# EasyEDA Pro project kuafu01_030内部老化方案.eprj, board PCB4 (continued)
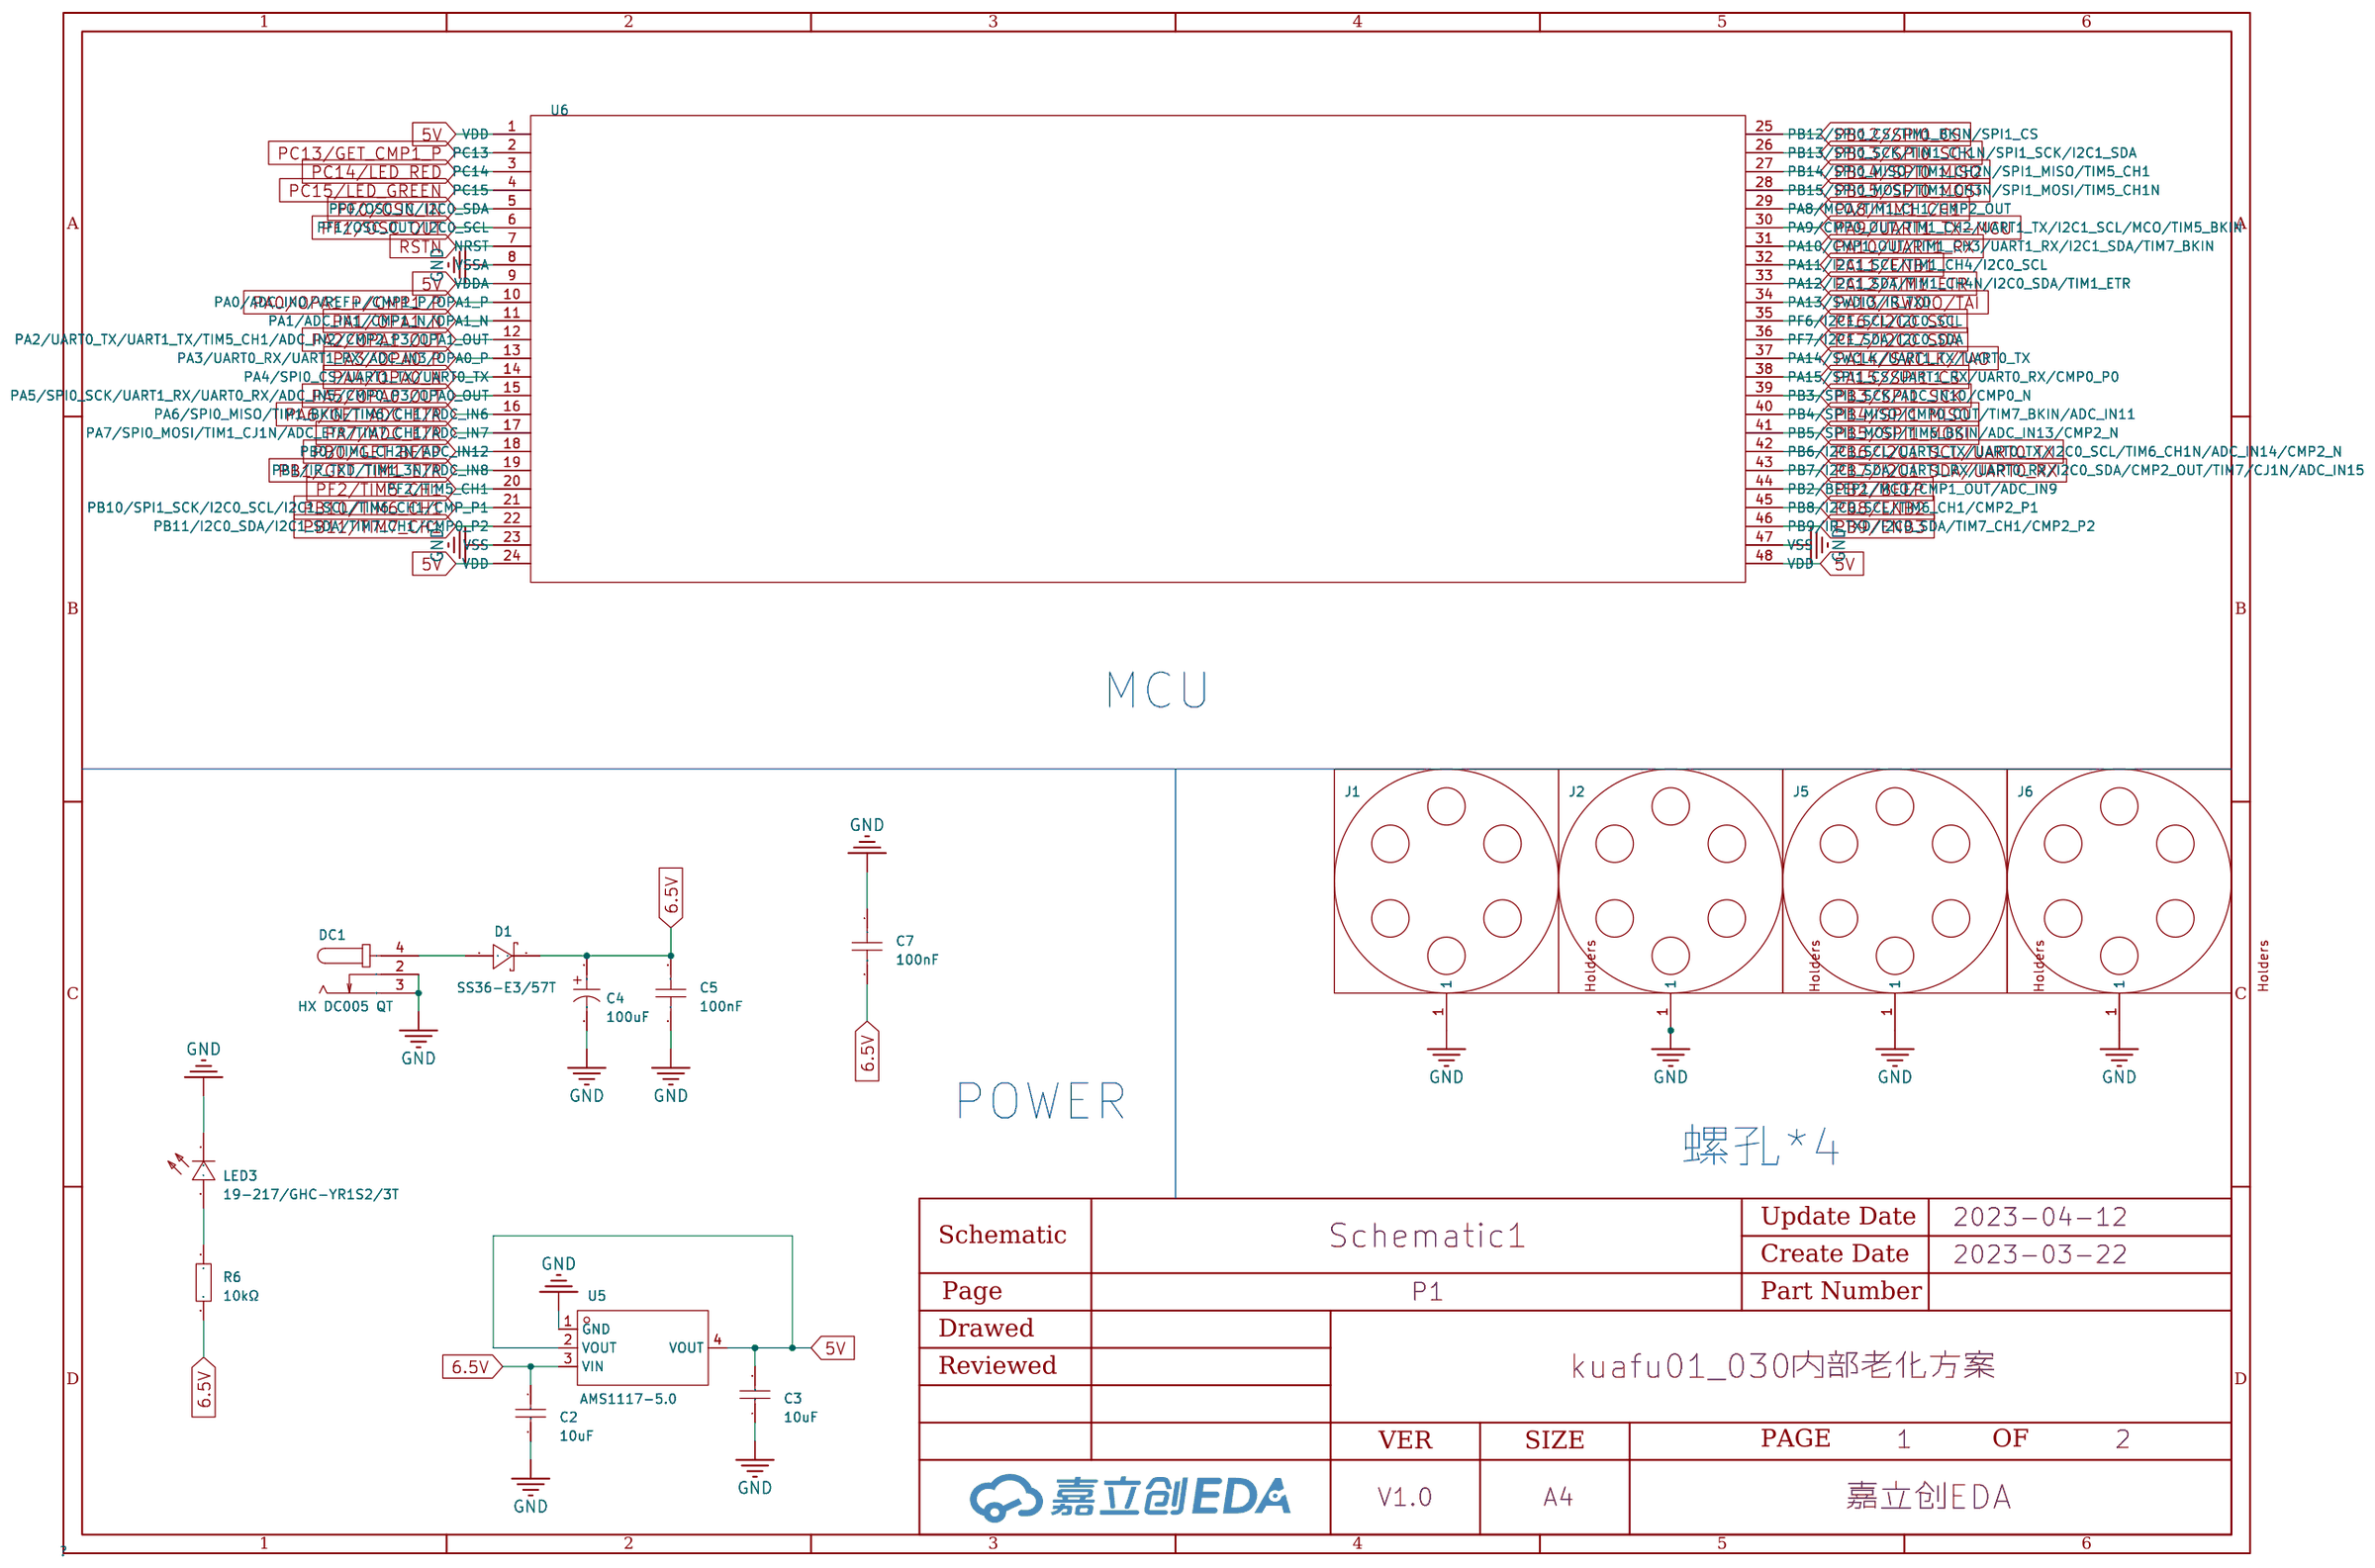
[diagram p0: P1]
## Placement (name value [footprint] x y rotation side) (continued)
R2#15  -  [R0603]  39.04 134.07 180 top
R2#16  -  [R0603]  89.84 134.07 180 top
R2#17  -  [R0603]  140.64 134.07 180 top
R2#18  -  [R0603]  191.44 134.07 180 top
R2#19  -  [R0603]  242.24 134.07 180 top
R2#20  -  [R0603]  293.04 134.07 180 top
R2#21  -  [R0603]  39.04 83.27 180 top
R2#22  -  [R0603]  89.84 83.27 180 top
R2#23  -  [R0603]  140.64 83.27 180 top
R2#24  -  [R0603]  191.44 83.27 180 top
R2#25  -  [R0603]  242.24 83.27 180 top
R2#26  -  [R0603]  293.04 83.27 180 top
R2#27  -  [R0603]  39.04 32.47 180 top
R2#28  -  [R0603]  89.84 32.47 180 top
R2#29  -  [R0603]  140.64 32.47 180 top
R2#30  -  [R0603]  191.44 32.47 180 top
R2#31  -  [R0603]  242.24 32.47 180 top
R2#32  -  [R0603]  89.84 337.27 180 top
R2#33  -  [R0603]  140.64 337.27 180 top
R2#34  -  [R0603]  191.44 337.27 180 top
R2#35  -  [R0603]  242.24 337.27 180 top
R2#36  -  [R0603]  293.04 337.27 180 top
R2#37  -  [R0603]  39.04 286.47 180 top
R2#38  -  [R0603]  89.84 286.47 180 top
R2#39  -  [R0603]  140.64 286.47 180 top
R2#40  -  [R0603]  191.44 286.47 180 top
R3  150Ω  [R0603]  304.63 269.01 0 top
R3#2  -  [R0603]  50.63 218.21 0 top
R3#3  -  [R0603]  101.43 218.21 0 top
R3#4  -  [R0603]  152.23 218.21 0 top
R3#5  -  [R0603]  203.03 218.21 0 top
R3#6  -  [R0603]  253.83 218.21 0 top
R3#7  -  [R0603]  304.63 218.21 0 top
R3#8  -  [R0603]  50.63 167.41 0 top
R3#9  -  [R0603]  101.43 167.41 0 top
R3#10  -  [R0603]  152.23 167.41 0 top
R3#11  -  [R0603]  203.03 167.41 0 top
R3#12  -  [R0603]  253.83 167.41 0 top
R3#13  -  [R0603]  304.63 167.41 0 top
R3#14  -  [R0603]  50.63 116.61 0 top
R3#15  -  [R0603]  101.43 116.61 0 top
R3#16  -  [R0603]  152.23 116.61 0 top
R3#17  -  [R0603]  203.03 116.61 0 top
R3#18  -  [R0603]  253.83 116.61 0 top
R3#19  -  [R0603]  304.63 116.61 0 top
R3#20  -  [R0603]  50.63 65.81 0 top
R3#21  -  [R0603]  101.43 65.81 0 top
R3#22  -  [R0603]  152.23 65.81 0 top
R3#23  -  [R0603]  203.03 65.81 0 top
R3#24  -  [R0603]  253.83 65.81 0 top
R3#25  -  [R0603]  304.63 65.81 0 top
R3#26  -  [R0603]  50.63 15.01 0 top
R3#27  -  [R0603]  101.43 15.01 0 top
R3#28  -  [R0603]  152.23 15.01 0 top
R3#29  -  [R0603]  203.03 15.01 0 top
R3#30  -  [R0603]  253.83 15.01 0 top
R3#31  -  [R0603]  101.43 319.81 0 top
R3#32  -  [R0603]  152.23 319.81 0 top
R3#33  -  [R0603]  203.03 319.81 0 top
R3#34  -  [R0603]  253.83 319.81 0 top
R3#35  -  [R0603]  304.63 319.81 0 top
R3#36  -  [R0603]  50.63 269.01 0 top
R3#37  -  [R0603]  101.43 269.01 0 top
R3#38  -  [R0603]  152.23 269.01 0 top
R3#39  -  [R0603]  203.03 269.01 0 top
R3#40  -  [R0603]  253.83 269.01 0 top
R4  0603WAF4701T5E/4.7KΩ  [R0603]  313.93 276.14 0 top
R4#2  -  [R0603]  59.93 225.34 0 top
R4#3  -  [R0603]  110.73 225.34 0 top
R4#4  -  [R0603]  161.53 225.34 0 top
R4#5  -  [R0603]  212.33 225.34 0 top
R4#6  -  [R0603]  263.13 225.34 0 top
R4#7  -  [R0603]  313.93 225.34 0 top
R4#8  -  [R0603]  59.93 174.54 0 top
R4#9  -  [R0603]  110.73 174.54 0 top
R4#10  -  [R0603]  161.53 174.54 0 top
R4#11  -  [R0603]  212.33 174.54 0 top
R4#12  -  [R0603]  263.13 174.54 0 top
R4#13  -  [R0603]  313.93 174.54 0 top
R4#14  -  [R0603]  59.93 123.74 0 top
R4#15  -  [R0603]  110.73 123.74 0 top
R4#16  -  [R0603]  161.53 123.74 0 top
R4#17  -  [R0603]  212.33 123.74 0 top
R4#18  -  [R0603]  263.13 123.74 0 top
R4#19  -  [R0603]  313.93 123.74 0 top
R4#20  -  [R0603]  59.93 72.94 0 top
R4#21  -  [R0603]  110.73 72.94 0 top
R4#22  -  [R0603]  161.53 72.94 0 top
R4#23  -  [R0603]  212.33 72.94 0 top
R4#24  -  [R0603]  263.13 72.94 0 top
R4#25  -  [R0603]  313.93 72.94 0 top
R4#26  -  [R0603]  59.93 22.14 0 top
R4#27  -  [R0603]  110.73 22.14 0 top
R4#28  -  [R0603]  161.53 22.14 0 top
R4#29  -  [R0603]  212.33 22.14 0 top
R4#30  -  [R0603]  263.13 22.14 0 top
R4#31  -  [R0603]  110.73 326.94 0 top
R4#32  -  [R0603]  161.53 326.94 0 top
R4#33  -  [R0603]  212.33 326.94 0 top
R4#34  -  [R0603]  263.13 326.94 0 top
R4#35  -  [R0603]  313.93 326.94 0 top
R4#36  -  [R0603]  59.93 276.14 0 top
R4#37  -  [R0603]  110.73 276.14 0 top
R4#38  -  [R0603]  161.53 276.14 0 top
R4#39  -  [R0603]  212.33 276.14 0 top
R4#40  -  [R0603]  263.13 276.14 0 top
R5  0603WAF4701T5E/4.7KΩ  [R0603]  313.92 274.52 0 top
R5#2  -  [R0603]  59.92 223.72 0 top
R5#3  -  [R0603]  110.72 223.72 0 top
R5#4  -  [R0603]  161.52 223.72 0 top
R5#5  -  [R0603]  212.32 223.72 0 top
R5#6  -  [R0603]  263.12 223.72 0 top
R5#7  -  [R0603]  313.92 223.72 0 top
R5#8  -  [R0603]  59.92 172.92 0 top
R5#9  -  [R0603]  110.72 172.92 0 top
R5#10  -  [R0603]  161.52 172.92 0 top
R5#11  -  [R0603]  212.32 172.92 0 top
R5#12  -  [R0603]  263.12 172.92 0 top
R5#13  -  [R0603]  313.92 172.92 0 top
R5#14  -  [R0603]  59.92 122.12 0 top
R5#15  -  [R0603]  263.12 20.52 0 top
R5#16  -  [R0603]  110.72 122.12 0 top
R5#17  -  [R0603]  161.52 122.12 0 top
R5#18  -  [R0603]  212.32 122.12 0 top
R5#19  -  [R0603]  263.12 122.12 0 top
R5#20  -  [R0603]  313.92 122.12 0 top
R5#21  -  [R0603]  59.92 71.32 0 top
R5#22  -  [R0603]  110.72 71.32 0 top
R5#23  -  [R0603]  161.52 71.32 0 top
R5#24  -  [R0603]  212.32 71.32 0 top
R5#25  -  [R0603]  263.12 71.32 0 top
R5#26  -  [R0603]  313.92 71.32 0 top
R5#27  -  [R0603]  59.92 20.52 0 top
R5#28  -  [R0603]  110.72 20.52 0 top
R5#29  -  [R0603]  161.52 20.52 0 top
R5#30  -  [R0603]  212.32 20.52 0 top
R5#31  -  [R0603]  110.72 325.32 0 top
R5#32  -  [R0603]  161.52 325.32 0 top
R5#33  -  [R0603]  212.32 325.32 0 top
R5#34  -  [R0603]  263.12 325.32 0 top
R5#35  -  [R0603]  313.92 325.32 0 top
R5#36  -  [R0603]  59.92 274.52 0 top
R5#37  -  [R0603]  110.72 274.52 0 top
R5#38  -  [R0603]  161.52 274.52 0 top
R5#39  -  [R0603]  212.32 274.52 0 top
R5#40  -  [R0603]  263.12 274.52 0 top
R6  10kΩ  [R0603]  57.37 352.99 90 top
U1  REF2920AIDBZR  [SOT-23-3_L2.9-W1.3-P1.90-LS2.4-BR]  246.56 273.14 0 top
U1#2  -  [SOT-23-3_L2.9-W1.3-P1.90-LS2.4-BR]  297.36 273.14 0 top
U1#3  -  [SOT-23-3_L2.9-W1.3-P1.90-LS2.4-BR]  43.36 222.34 0 top
U1#4  -  [SOT-23-3_L2.9-W1.3-P1.90-LS2.4-BR]  94.16 222.34 0 top
U1#5  -  [SOT-23-3_L2.9-W1.3-P1.90-LS2.4-BR]  144.96 222.34 0 top
U1#6  -  [SOT-23-3_L2.9-W1.3-P1.90-LS2.4-BR]  195.76 222.34 0 top
U1#7  -  [SOT-23-3_L2.9-W1.3-P1.90-LS2.4-BR]  246.56 222.34 0 top
U1#8  -  [SOT-23-3_L2.9-W1.3-P1.90-LS2.4-BR]  297.36 222.34 0 top
U1#9  -  [SOT-23-3_L2.9-W1.3-P1.90-LS2.4-BR]  43.36 171.54 0 top
U1#10  -  [SOT-23-3_L2.9-W1.3-P1.90-LS2.4-BR]  94.16 171.54 0 top
U1#11  -  [SOT-23-3_L2.9-W1.3-P1.90-LS2.4-BR]  144.96 171.54 0 top
U1#12  -  [SOT-23-3_L2.9-W1.3-P1.90-LS2.4-BR]  195.76 171.54 0 top
U1#13  -  [SOT-23-3_L2.9-W1.3-P1.90-LS2.4-BR]  246.56 171.54 0 top
U1#14  -  [SOT-23-3_L2.9-W1.3-P1.90-LS2.4-BR]  297.36 171.54 0 top
U1#15  -  [SOT-23-3_L2.9-W1.3-P1.90-LS2.4-BR]  43.36 120.74 0 top
U1#16  -  [SOT-23-3_L2.9-W1.3-P1.90-LS2.4-BR]  94.16 120.74 0 top
U1#17  -  [SOT-23-3_L2.9-W1.3-P1.90-LS2.4-BR]  144.96 120.74 0 top
U1#18  -  [SOT-23-3_L2.9-W1.3-P1.90-LS2.4-BR]  195.76 120.74 0 top
U1#19  -  [SOT-23-3_L2.9-W1.3-P1.90-LS2.4-BR]  246.56 120.74 0 top
U1#20  -  [SOT-23-3_L2.9-W1.3-P1.90-LS2.4-BR]  297.36 120.74 0 top
U1#21  -  [SOT-23-3_L2.9-W1.3-P1.90-LS2.4-BR]  43.36 69.94 0 top
U1#22  -  [SOT-23-3_L2.9-W1.3-P1.90-LS2.4-BR]  94.16 69.94 0 top
U1#23  -  [SOT-23-3_L2.9-W1.3-P1.90-LS2.4-BR]  144.96 69.94 0 top
U1#24  -  [SOT-23-3_L2.9-W1.3-P1.90-LS2.4-BR]  195.76 69.94 0 top
U1#25  -  [SOT-23-3_L2.9-W1.3-P1.90-LS2.4-BR]  246.56 69.94 0 top
U1#26  -  [SOT-23-3_L2.9-W1.3-P1.90-LS2.4-BR]  297.36 69.94 0 top
U1#27  -  [SOT-23-3_L2.9-W1.3-P1.90-LS2.4-BR]  43.36 19.14 0 top
U1#28  -  [SOT-23-3_L2.9-W1.3-P1.90-LS2.4-BR]  94.16 19.14 0 top
U1#29  -  [SOT-23-3_L2.9-W1.3-P1.90-LS2.4-BR]  144.96 19.14 0 top
U1#30  -  [SOT-23-3_L2.9-W1.3-P1.90-LS2.4-BR]  195.76 19.14 0 top
U1#31  -  [SOT-23-3_L2.9-W1.3-P1.90-LS2.4-BR]  246.56 19.14 0 top
U1#32  -  [SOT-23-3_L2.9-W1.3-P1.90-LS2.4-BR]  94.16 323.94 0 top
U1#33  -  [SOT-23-3_L2.9-W1.3-P1.90-LS2.4-BR]  144.96 323.94 0 top
U1#34  -  [SOT-23-3_L2.9-W1.3-P1.90-LS2.4-BR]  195.76 323.94 0 top
U1#35  -  [SOT-23-3_L2.9-W1.3-P1.90-LS2.4-BR]  246.56 323.94 0 top
U1#36  -  [SOT-23-3_L2.9-W1.3-P1.90-LS2.4-BR]  297.36 323.94 0 top
U1#37  -  [SOT-23-3_L2.9-W1.3-P1.90-LS2.4-BR]  43.36 273.14 0 top
U1#38  -  [SOT-23-3_L2.9-W1.3-P1.90-LS2.4-BR]  94.16 273.14 0 top
U1#39  -  [SOT-23-3_L2.9-W1.3-P1.90-LS2.4-BR]  144.96 273.14 0 top
U1#40  -  [SOT-23-3_L2.9-W1.3-P1.90-LS2.4-BR]  195.76 273.14 0 top
U2  BL1551B  [SC-70-6_L2.1-W1.3-P0.65-LS2.3-BR]  240.61 273.47 180 top
U2#2  -  [SC-70-6_L2.1-W1.3-P0.65-LS2.3-BR]  291.41 273.47 180 top
U2#3  -  [SC-70-6_L2.1-W1.3-P0.65-LS2.3-BR]  37.41 222.67 180 top
U2#4  -  [SC-70-6_L2.1-W1.3-P0.65-LS2.3-BR]  88.21 222.67 180 top
U2#5  -  [SC-70-6_L2.1-W1.3-P0.65-LS2.3-BR]  139.01 222.67 180 top
U2#6  -  [SC-70-6_L2.1-W1.3-P0.65-LS2.3-BR]  189.81 222.67 180 top
U2#7  -  [SC-70-6_L2.1-W1.3-P0.65-LS2.3-BR]  240.61 222.67 180 top
U2#8  -  [SC-70-6_L2.1-W1.3-P0.65-LS2.3-BR]  291.41 222.67 180 top
U2#9  -  [SC-70-6_L2.1-W1.3-P0.65-LS2.3-BR]  37.41 171.87 180 top
U2#10  -  [SC-70-6_L2.1-W1.3-P0.65-LS2.3-BR]  88.21 171.87 180 top
U2#11  -  [SC-70-6_L2.1-W1.3-P0.65-LS2.3-BR]  139.01 171.87 180 top
U2#12  -  [SC-70-6_L2.1-W1.3-P0.65-LS2.3-BR]  189.81 171.87 180 top
U2#13  -  [SC-70-6_L2.1-W1.3-P0.65-LS2.3-BR]  240.61 171.87 180 top
U2#14  -  [SC-70-6_L2.1-W1.3-P0.65-LS2.3-BR]  291.41 171.87 180 top
U2#15  -  [SC-70-6_L2.1-W1.3-P0.65-LS2.3-BR]  37.41 121.07 180 top
U2#16  -  [SC-70-6_L2.1-W1.3-P0.65-LS2.3-BR]  88.21 121.07 180 top
U2#17  -  [SC-70-6_L2.1-W1.3-P0.65-LS2.3-BR]  139.01 121.07 180 top
U2#18  -  [SC-70-6_L2.1-W1.3-P0.65-LS2.3-BR]  189.81 121.07 180 top
U2#19  -  [SC-70-6_L2.1-W1.3-P0.65-LS2.3-BR]  240.61 121.07 180 top
U2#20  -  [SC-70-6_L2.1-W1.3-P0.65-LS2.3-BR]  291.41 121.07 180 top
U2#21  -  [SC-70-6_L2.1-W1.3-P0.65-LS2.3-BR]  37.41 70.27 180 top
U2#22  -  [SC-70-6_L2.1-W1.3-P0.65-LS2.3-BR]  88.21 70.27 180 top
U2#23  -  [SC-70-6_L2.1-W1.3-P0.65-LS2.3-BR]  139.01 70.27 180 top
U2#24  -  [SC-70-6_L2.1-W1.3-P0.65-LS2.3-BR]  189.81 70.27 180 top
U2#25  -  [SC-70-6_L2.1-W1.3-P0.65-LS2.3-BR]  240.61 70.27 180 top
U2#26  -  [SC-70-6_L2.1-W1.3-P0.65-LS2.3-BR]  291.41 70.27 180 top
U2#27  -  [SC-70-6_L2.1-W1.3-P0.65-LS2.3-BR]  37.41 19.47 180 top
U2#28  -  [SC-70-6_L2.1-W1.3-P0.65-LS2.3-BR]  88.21 19.47 180 top
U2#29  -  [SC-70-6_L2.1-W1.3-P0.65-LS2.3-BR]  139.01 19.47 180 top
U2#30  -  [SC-70-6_L2.1-W1.3-P0.65-LS2.3-BR]  189.81 19.47 180 top
U2#31  -  [SC-70-6_L2.1-W1.3-P0.65-LS2.3-BR]  240.61 19.47 180 top
U2#32  -  [SC-70-6_L2.1-W1.3-P0.65-LS2.3-BR]  88.21 324.27 180 top
U2#33  -  [SC-70-6_L2.1-W1.3-P0.65-LS2.3-BR]  139.01 324.27 180 top
U2#34  -  [SC-70-6_L2.1-W1.3-P0.65-LS2.3-BR]  189.81 324.27 180 top
U2#35  -  [SC-70-6_L2.1-W1.3-P0.65-LS2.3-BR]  240.61 324.27 180 top
U2#36  -  [SC-70-6_L2.1-W1.3-P0.65-LS2.3-BR]  291.41 324.27 180 top
U2#37  -  [SC-70-6_L2.1-W1.3-P0.65-LS2.3-BR]  37.41 273.47 180 top
U2#38  -  [SC-70-6_L2.1-W1.3-P0.65-LS2.3-BR]  88.21 273.47 180 top
U2#39  -  [SC-70-6_L2.1-W1.3-P0.65-LS2.3-BR]  139.01 273.47 180 top
U2#40  -  [SC-70-6_L2.1-W1.3-P0.65-LS2.3-BR]  189.81 273.47 180 top
U3  BL1551B  [SC-70-6_L2.1-W1.3-P0.65-LS2.3-BR]  263.53 284.83 0 top
U3#2  -  [SC-70-6_L2.1-W1.3-P0.65-LS2.3-BR]  314.33 284.83 0 top
U3#3  -  [SC-70-6_L2.1-W1.3-P0.65-LS2.3-BR]  60.33 234.03 0 top
U3#4  -  [SC-70-6_L2.1-W1.3-P0.65-LS2.3-BR]  111.13 234.03 0 top
U3#5  -  [SC-70-6_L2.1-W1.3-P0.65-LS2.3-BR]  161.93 234.03 0 top
U3#6  -  [SC-70-6_L2.1-W1.3-P0.65-LS2.3-BR]  212.73 234.03 0 top
U3#7  -  [SC-70-6_L2.1-W1.3-P0.65-LS2.3-BR]  263.53 234.03 0 top
U3#8  -  [SC-70-6_L2.1-W1.3-P0.65-LS2.3-BR]  314.33 234.03 0 top
U3#9  -  [SC-70-6_L2.1-W1.3-P0.65-LS2.3-BR]  60.33 183.23 0 top
U3#10  -  [SC-70-6_L2.1-W1.3-P0.65-LS2.3-BR]  111.13 183.23 0 top
U3#11  -  [SC-70-6_L2.1-W1.3-P0.65-LS2.3-BR]  161.93 183.23 0 top
U3#12  -  [SC-70-6_L2.1-W1.3-P0.65-LS2.3-BR]  212.73 183.23 0 top
U3#13  -  [SC-70-6_L2.1-W1.3-P0.65-LS2.3-BR]  263.53 183.23 0 top
U3#14  -  [SC-70-6_L2.1-W1.3-P0.65-LS2.3-BR]  314.33 183.23 0 top
U3#15  -  [SC-70-6_L2.1-W1.3-P0.65-LS2.3-BR]  60.33 132.43 0 top
U3#16  -  [SC-70-6_L2.1-W1.3-P0.65-LS2.3-BR]  111.13 132.43 0 top
U3#17  -  [SC-70-6_L2.1-W1.3-P0.65-LS2.3-BR]  161.93 132.43 0 top
U3#18  -  [SC-70-6_L2.1-W1.3-P0.65-LS2.3-BR]  212.73 132.43 0 top
U3#19  -  [SC-70-6_L2.1-W1.3-P0.65-LS2.3-BR]  263.53 132.43 0 top
U3#20  -  [SC-70-6_L2.1-W1.3-P0.65-LS2.3-BR]  314.33 132.43 0 top
U3#21  -  [SC-70-6_L2.1-W1.3-P0.65-LS2.3-BR]  60.33 81.63 0 top
U3#22  -  [SC-70-6_L2.1-W1.3-P0.65-LS2.3-BR]  111.13 81.63 0 top
U3#23  -  [SC-70-6_L2.1-W1.3-P0.65-LS2.3-BR]  161.93 81.63 0 top
U3#24  -  [SC-70-6_L2.1-W1.3-P0.65-LS2.3-BR]  212.73 81.63 0 top
U3#25  -  [SC-70-6_L2.1-W1.3-P0.65-LS2.3-BR]  263.53 81.63 0 top
U3#26  -  [SC-70-6_L2.1-W1.3-P0.65-LS2.3-BR]  314.33 81.63 0 top
U3#27  -  [SC-70-6_L2.1-W1.3-P0.65-LS2.3-BR]  60.33 30.83 0 top
U3#28  -  [SC-70-6_L2.1-W1.3-P0.65-LS2.3-BR]  111.13 30.83 0 top
U3#29  -  [SC-70-6_L2.1-W1.3-P0.65-LS2.3-BR]  161.93 30.83 0 top
U3#30  -  [SC-70-6_L2.1-W1.3-P0.65-LS2.3-BR]  212.73 30.83 0 top
U3#31  -  [SC-70-6_L2.1-W1.3-P0.65-LS2.3-BR]  263.53 30.83 0 top
U3#32  -  [SC-70-6_L2.1-W1.3-P0.65-LS2.3-BR]  111.13 335.63 0 top
U3#33  -  [SC-70-6_L2.1-W1.3-P0.65-LS2.3-BR]  161.93 335.63 0 top
U3#34  -  [SC-70-6_L2.1-W1.3-P0.65-LS2.3-BR]  212.73 335.63 0 top
U3#35  -  [SC-70-6_L2.1-W1.3-P0.65-LS2.3-BR]  263.53 335.63 0 top
U3#36  -  [SC-70-6_L2.1-W1.3-P0.65-LS2.3-BR]  314.33 335.63 0 top
U3#37  -  [SC-70-6_L2.1-W1.3-P0.65-LS2.3-BR]  60.33 284.83 0 top
U3#38  -  [SC-70-6_L2.1-W1.3-P0.65-LS2.3-BR]  111.13 284.83 0 top
U3#39  -  [SC-70-6_L2.1-W1.3-P0.65-LS2.3-BR]  161.93 284.83 0 top
U3#40  -  [SC-70-6_L2.1-W1.3-P0.65-LS2.3-BR]  212.73 284.83 0 top
U4  BL1551B  [SC-70-6_L2.1-W1.3-P0.65-LS2.3-BR]  248.74 288.05 90 top
U4#2  -  [SC-70-6_L2.1-W1.3-P0.65-LS2.3-BR]  299.54 288.05 90 top
U4#3  -  [SC-70-6_L2.1-W1.3-P0.65-LS2.3-BR]  45.54 237.25 90 top
U4#4  -  [SC-70-6_L2.1-W1.3-P0.65-LS2.3-BR]  96.34 237.25 90 top
U4#5  -  [SC-70-6_L2.1-W1.3-P0.65-LS2.3-BR]  147.14 237.25 90 top
U4#6  -  [SC-70-6_L2.1-W1.3-P0.65-LS2.3-BR]  197.94 237.25 90 top
U4#7  -  [SC-70-6_L2.1-W1.3-P0.65-LS2.3-BR]  248.74 237.25 90 top
U4#8  -  [SC-70-6_L2.1-W1.3-P0.65-LS2.3-BR]  299.54 237.25 90 top
U4#9  -  [SC-70-6_L2.1-W1.3-P0.65-LS2.3-BR]  45.54 186.45 90 top
U4#10  -  [SC-70-6_L2.1-W1.3-P0.65-LS2.3-BR]  96.34 186.45 90 top
U4#11  -  [SC-70-6_L2.1-W1.3-P0.65-LS2.3-BR]  147.14 186.45 90 top
U4#12  -  [SC-70-6_L2.1-W1.3-P0.65-LS2.3-BR]  197.94 186.45 90 top
U4#13  -  [SC-70-6_L2.1-W1.3-P0.65-LS2.3-BR]  248.74 186.45 90 top
U4#14  -  [SC-70-6_L2.1-W1.3-P0.65-LS2.3-BR]  299.54 186.45 90 top
U4#15  -  [SC-70-6_L2.1-W1.3-P0.65-LS2.3-BR]  45.54 135.65 90 top
U4#16  -  [SC-70-6_L2.1-W1.3-P0.65-LS2.3-BR]  96.34 135.65 90 top
U4#17  -  [SC-70-6_L2.1-W1.3-P0.65-LS2.3-BR]  147.14 135.65 90 top
U4#18  -  [SC-70-6_L2.1-W1.3-P0.65-LS2.3-BR]  197.94 135.65 90 top
U4#19  -  [SC-70-6_L2.1-W1.3-P0.65-LS2.3-BR]  248.74 135.65 90 top
U4#20  -  [SC-70-6_L2.1-W1.3-P0.65-LS2.3-BR]  299.54 135.65 90 top
U4#21  -  [SC-70-6_L2.1-W1.3-P0.65-LS2.3-BR]  45.54 84.85 90 top
U4#22  -  [SC-70-6_L2.1-W1.3-P0.65-LS2.3-BR]  96.34 84.85 90 top
U4#23  -  [SC-70-6_L2.1-W1.3-P0.65-LS2.3-BR]  147.14 84.85 90 top
U4#24  -  [SC-70-6_L2.1-W1.3-P0.65-LS2.3-BR]  197.94 84.85 90 top
U4#25  -  [SC-70-6_L2.1-W1.3-P0.65-LS2.3-BR]  248.74 84.85 90 top
U4#26  -  [SC-70-6_L2.1-W1.3-P0.65-LS2.3-BR]  299.54 84.85 90 top
U4#27  -  [SC-70-6_L2.1-W1.3-P0.65-LS2.3-BR]  45.54 34.05 90 top
U4#28  -  [SC-70-6_L2.1-W1.3-P0.65-LS2.3-BR]  96.34 34.05 90 top
U4#29  -  [SC-70-6_L2.1-W1.3-P0.65-LS2.3-BR]  147.14 34.05 90 top
U4#30  -  [SC-70-6_L2.1-W1.3-P0.65-LS2.3-BR]  197.94 34.05 90 top
U4#31  -  [SC-70-6_L2.1-W1.3-P0.65-LS2.3-BR]  248.74 34.05 90 top
U4#32  -  [SC-70-6_L2.1-W1.3-P0.65-LS2.3-BR]  96.34 338.85 90 top
U4#33  -  [SC-70-6_L2.1-W1.3-P0.65-LS2.3-BR]  147.14 338.85 90 top
U4#34  -  [SC-70-6_L2.1-W1.3-P0.65-LS2.3-BR]  197.94 338.85 90 top
U4#35  -  [SC-70-6_L2.1-W1.3-P0.65-LS2.3-BR]  248.74 338.85 90 top
U4#36  -  [SC-70-6_L2.1-W1.3-P0.65-LS2.3-BR]  299.54 338.85 90 top
U4#37  -  [SC-70-6_L2.1-W1.3-P0.65-LS2.3-BR]  45.54 288.05 90 top
U4#38  -  [SC-70-6_L2.1-W1.3-P0.65-LS2.3-BR]  96.34 288.05 90 top
U4#39  -  [SC-70-6_L2.1-W1.3-P0.65-LS2.3-BR]  147.14 288.05 90 top
U4#40  -  [SC-70-6_L2.1-W1.3-P0.65-LS2.3-BR]  197.94 288.05 90 top
U5  AMS1117-5.0  [SOT-223_L6.5-W3.5-P2.30-LS7.0-BR]  49.14 330.84 90 top
U5#2  -  [SOT-223_L6.5-W3.5-P2.30-LS7.0-BR]  69.01 356.02 180 top
U5#3  -  [SOT-223_L6.5-W3.5-P2.30-LS7.0-BR]  64.86 330.84 90 top
U5#4  -  [SOT-223_L6.5-W3.5-P2.30-LS7.0-BR]  33.52 330.94 90 top
U6  PT32A030C8T7  [LQFP-48_L7.0-W7.0-P0.50-LS9.0-BL-EP5.4]  254.83 280.75 270 top
U6#2  -  [LQFP-48_L7.0-W7.0-P0.50-LS9.0-BL-EP5.4]  305.63 280.75 270 top
U6#3  -  [LQFP-48_L7.0-W7.0-P0.50-LS9.0-BL-EP5.4]  51.63 229.95 270 top
U6#4  -  [LQFP-48_L7.0-W7.0-P0.50-LS9.0-BL-EP5.4]  102.43 229.95 270 top
U6#5  -  [LQFP-48_L7.0-W7.0-P0.50-LS9.0-BL-EP5.4]  153.23 229.95 270 top
U6#6  -  [LQFP-48_L7.0-W7.0-P0.50-LS9.0-BL-EP5.4]  204.03 229.95 270 top
U6#7  -  [LQFP-48_L7.0-W7.0-P0.50-LS9.0-BL-EP5.4]  254.83 229.95 270 top
U6#8  -  [LQFP-48_L7.0-W7.0-P0.50-LS9.0-BL-EP5.4]  305.63 229.95 270 top
U6#9  -  [LQFP-48_L7.0-W7.0-P0.50-LS9.0-BL-EP5.4]  51.63 179.15 270 top
U6#10  -  [LQFP-48_L7.0-W7.0-P0.50-LS9.0-BL-EP5.4]  102.43 179.15 270 top
U6#11  -  [LQFP-48_L7.0-W7.0-P0.50-LS9.0-BL-EP5.4]  153.23 179.15 270 top
U6#12  -  [LQFP-48_L7.0-W7.0-P0.50-LS9.0-BL-EP5.4]  204.03 179.15 270 top
U6#13  -  [LQFP-48_L7.0-W7.0-P0.50-LS9.0-BL-EP5.4]  254.83 179.15 270 top
U6#14  -  [LQFP-48_L7.0-W7.0-P0.50-LS9.0-BL-EP5.4]  305.63 179.15 270 top
U6#15  -  [LQFP-48_L7.0-W7.0-P0.50-LS9.0-BL-EP5.4]  51.63 128.35 270 top
U6#16  -  [LQFP-48_L7.0-W7.0-P0.50-LS9.0-BL-EP5.4]  102.43 128.35 270 top
U6#17  -  [LQFP-48_L7.0-W7.0-P0.50-LS9.0-BL-EP5.4]  153.23 128.35 270 top
U6#18  -  [LQFP-48_L7.0-W7.0-P0.50-LS9.0-BL-EP5.4]  204.03 128.35 270 top
U6#19  -  [LQFP-48_L7.0-W7.0-P0.50-LS9.0-BL-EP5.4]  254.83 128.35 270 top
U6#20  -  [LQFP-48_L7.0-W7.0-P0.50-LS9.0-BL-EP5.4]  305.63 128.35 270 top
U6#21  -  [LQFP-48_L7.0-W7.0-P0.50-LS9.0-BL-EP5.4]  51.63 77.55 270 top
U6#22  -  [LQFP-48_L7.0-W7.0-P0.50-LS9.0-BL-EP5.4]  102.43 77.55 270 top
U6#23  -  [LQFP-48_L7.0-W7.0-P0.50-LS9.0-BL-EP5.4]  153.23 77.55 270 top
U6#24  -  [LQFP-48_L7.0-W7.0-P0.50-LS9.0-BL-EP5.4]  204.03 77.55 270 top
U6#25  -  [LQFP-48_L7.0-W7.0-P0.50-LS9.0-BL-EP5.4]  254.83 77.55 270 top
U6#26  -  [LQFP-48_L7.0-W7.0-P0.50-LS9.0-BL-EP5.4]  305.63 77.55 270 top
U6#27  -  [LQFP-48_L7.0-W7.0-P0.50-LS9.0-BL-EP5.4]  51.63 26.75 270 top
U6#28  -  [LQFP-48_L7.0-W7.0-P0.50-LS9.0-BL-EP5.4]  102.43 26.75 270 top
U6#29  -  [LQFP-48_L7.0-W7.0-P0.50-LS9.0-BL-EP5.4]  153.23 26.75 270 top
U6#30  -  [LQFP-48_L7.0-W7.0-P0.50-LS9.0-BL-EP5.4]  204.03 26.75 270 top
U6#31  -  [LQFP-48_L7.0-W7.0-P0.50-LS9.0-BL-EP5.4]  254.83 26.75 270 top
U6#32  -  [LQFP-48_L7.0-W7.0-P0.50-LS9.0-BL-EP5.4]  102.43 331.55 270 top
U6#33  -  [LQFP-48_L7.0-W7.0-P0.50-LS9.0-BL-EP5.4]  153.23 331.55 270 top
U6#34  -  [LQFP-48_L7.0-W7.0-P0.50-LS9.0-BL-EP5.4]  204.03 331.55 270 top
U6#35  -  [LQFP-48_L7.0-W7.0-P0.50-LS9.0-BL-EP5.4]  254.83 331.55 270 top
U6#36  -  [LQFP-48_L7.0-W7.0-P0.50-LS9.0-BL-EP5.4]  305.63 331.55 270 top
U6#37  -  [LQFP-48_L7.0-W7.0-P0.50-LS9.0-BL-EP5.4]  51.63 280.75 270 top
U6#38  -  [LQFP-48_L7.0-W7.0-P0.50-LS9.0-BL-EP5.4]  102.43 280.75 270 top
U6#39  -  [LQFP-48_L7.0-W7.0-P0.50-LS9.0-BL-EP5.4]  153.23 280.75 270 top
U6#40  -  [LQFP-48_L7.0-W7.0-P0.50-LS9.0-BL-EP5.4]  204.03 280.75 270 top
X1  25MHz  [OSC-SMD_4P-L2.5-W2.0-BL]  240.19 283.18 180 top
X1#2  -  [OSC-SMD_4P-L2.5-W2.0-BL]  290.99 283.18 180 top
X1#3  -  [OSC-SMD_4P-L2.5-W2.0-BL]  36.99 232.38 180 top
X1#4  -  [OSC-SMD_4P-L2.5-W2.0-BL]  87.79 232.38 180 top
X1#5  -  [OSC-SMD_4P-L2.5-W2.0-BL]  138.59 232.38 180 top
X1#6  -  [OSC-SMD_4P-L2.5-W2.0-BL]  189.39 232.38 180 top
X1#7  -  [OSC-SMD_4P-L2.5-W2.0-BL]  240.19 232.38 180 top
X1#8  -  [OSC-SMD_4P-L2.5-W2.0-BL]  290.99 232.38 180 top
X1#9  -  [OSC-SMD_4P-L2.5-W2.0-BL]  36.99 181.58 180 top
X1#10  -  [OSC-SMD_4P-L2.5-W2.0-BL]  87.79 181.58 180 top
X1#11  -  [OSC-SMD_4P-L2.5-W2.0-BL]  138.59 181.58 180 top
X1#12  -  [OSC-SMD_4P-L2.5-W2.0-BL]  189.39 181.58 180 top
X1#13  -  [OSC-SMD_4P-L2.5-W2.0-BL]  240.19 181.58 180 top
X1#14  -  [OSC-SMD_4P-L2.5-W2.0-BL]  290.99 181.58 180 top
X1#15  -  [OSC-SMD_4P-L2.5-W2.0-BL]  36.99 130.78 180 top
X1#16  -  [OSC-SMD_4P-L2.5-W2.0-BL]  87.79 130.78 180 top
X1#17  -  [OSC-SMD_4P-L2.5-W2.0-BL]  138.59 130.78 180 top
X1#18  -  [OSC-SMD_4P-L2.5-W2.0-BL]  189.39 130.78 180 top
X1#19  -  [OSC-SMD_4P-L2.5-W2.0-BL]  240.19 130.78 180 top
X1#20  -  [OSC-SMD_4P-L2.5-W2.0-BL]  290.99 130.78 180 top
X1#21  -  [OSC-SMD_4P-L2.5-W2.0-BL]  36.99 79.98 180 top
X1#22  -  [OSC-SMD_4P-L2.5-W2.0-BL]  87.79 79.98 180 top
X1#23  -  [OSC-SMD_4P-L2.5-W2.0-BL]  138.59 79.98 180 top
X1#24  -  [OSC-SMD_4P-L2.5-W2.0-BL]  189.39 79.98 180 top
X1#25  -  [OSC-SMD_4P-L2.5-W2.0-BL]  240.19 79.98 180 top
X1#26  -  [OSC-SMD_4P-L2.5-W2.0-BL]  290.99 79.98 180 top
X1#27  -  [OSC-SMD_4P-L2.5-W2.0-BL]  36.99 29.18 180 top
X1#28  -  [OSC-SMD_4P-L2.5-W2.0-BL]  87.79 29.18 180 top
X1#29  -  [OSC-SMD_4P-L2.5-W2.0-BL]  138.59 29.18 180 top
X1#30  -  [OSC-SMD_4P-L2.5-W2.0-BL]  189.39 29.18 180 top
X1#31  -  [OSC-SMD_4P-L2.5-W2.0-BL]  240.19 29.18 180 top
X1#32  -  [OSC-SMD_4P-L2.5-W2.0-BL]  87.79 333.98 180 top
X1#33  -  [OSC-SMD_4P-L2.5-W2.0-BL]  138.59 333.98 180 top
X1#34  -  [OSC-SMD_4P-L2.5-W2.0-BL]  189.39 333.98 180 top
X1#35  -  [OSC-SMD_4P-L2.5-W2.0-BL]  240.19 333.98 180 top
X1#36  -  [OSC-SMD_4P-L2.5-W2.0-BL]  290.99 333.98 180 top
X1#37  -  [OSC-SMD_4P-L2.5-W2.0-BL]  36.99 283.18 180 top
X1#38  -  [OSC-SMD_4P-L2.5-W2.0-BL]  87.79 283.18 180 top
X1#39  -  [OSC-SMD_4P-L2.5-W2.0-BL]  138.59 283.18 180 top
X1#40  -  [OSC-SMD_4P-L2.5-W2.0-BL]  189.39 283.18 180 top

## Footprints (pads in the part's own frame, mm; a bottom-side part is the same pattern mirrored in y, then rotated)
C0603
  rect 0.8x0.9 smd: 1(-0.7,0) 2(0.7,0)
C1206
  rect 1.485x1.728 smd: 1(-1.593,0) 2(1.593,0)
CAP-SMD_BD6.3-L6.6-W6.6-LS7.6-FD-1
  rect 3.5x1.2 smd: 1(-2.67,0) 2(2.67,0)
CONN-TH_4P-P2.50_XH-4A
  rect 1.8x1.8 hole 1.199: 1(-3.751,0)
  round 1.8 hole 1.199: 2(-1.25,0) 3(1.25,0) 4(3.751,0)
DC-IN-TH_HANXIA_HX-DC005-QT
  oval 3.6x1.4 hole 3x0.8: 2(0.15,-2.3)
  oval 1.7x3.6 hole 1x3: 3(-3.15,2.3) 4(3.15,2.3)
DEMO板安装孔
  round 6.32 hole 2.75: 1(0,0)
HDR-TH_2P-P2.54-V-M
  rect 2x2 hole 1.2: 1(-1.27,0)
  round 2 hole 1.2: 2(1.27,0)
IDC-TH_10P-P2.54-V-R2-C5-S2.54
  rect 1.8x1.8 hole 1.1: 1(-5.08,-1.27)
  round 1.8 hole 1.1: 2(-5.08,1.27) 3(-2.54,-1.27) 4(-2.54,1.27) 5(0,-1.27) 6(0,1.27) 7(2.54,-1.27) 8(2.54,1.27) 9(5.08,-1.27) 10(5.08,1.27)
LED0603-RD
  rect 0.8x0.8 smd: 1(-0.799,-0.004) 2(0.799,0.004)
LED0603-RD_RED
  rect 0.8x0.8 smd: 1(-0.799,-0.004) 2(0.799,0.004)
LQFP-48_L7.0-W7.0-P0.50-LS9.0-BL-EP5.4
  oval 0.28x1.6 smd: 1(-2.75,-4.2) 2(-2.25,-4.2) 3(-1.75,-4.2) 4(-1.25,-4.2) 5(-0.75,-4.2) 6(-0.25,-4.2) 7(0.25,-4.2) 8(0.75,-4.2) 9(1.25,-4.2) 10(1.75,-4.2) 11(2.25,-4.2) 12(2.75,-4.2) 25(2.75,4.2) 26(2.25,4.2) 27(1.75,4.2) 28(1.25,4.2) 29(0.75,4.2) 30(0.25,4.2) 31(-0.25,4.2) 32(-0.75,4.2) 33(-1.25,4.2) 34(-1.75,4.2) 35(-2.25,4.2) 36(-2.75,4.2)
  oval 1.6x0.28 smd: 13(4.2,-2.75) 14(4.2,-2.25) 15(4.2,-1.75) 16(4.2,-1.25) 17(4.2,-0.75) 18(4.2,-0.25) 19(4.2,0.25) 20(4.2,0.75) 21(4.2,1.25) 22(4.2,1.75) 23(4.2,2.25) 24(4.2,2.75) 37(-4.2,2.75) 38(-4.2,2.25) 39(-4.2,1.75) 40(-4.2,1.25) 41(-4.2,0.75) 42(-4.2,0.25) 43(-4.2,-0.25) 44(-4.2,-0.75) 45(-4.2,-1.25) 46(-4.2,-1.75) 47(-4.2,-2.25) 48(-4.2,-2.75)
  rect 5.4x5.4 smd: 49(0,0)
OSC-SMD_4P-L2.5-W2.0-BL
  rect 1.2x1.1 smd: 1(-0.95,-0.75) 2(0.95,-0.75) 3(0.95,0.75) 4(-0.95,0.75)
R0603
  rect 0.806x0.864 smd: 1(-0.753,0) 2(0.753,0)
SC-70-6_L2.1-W1.3-P0.65-LS2.3-BR
  rect 1x0.42 smd: 1(1.15,-0.65) 2(1.15,0) 3(1.15,0.65) 4(-1.15,0.65) 5(-1.15,0) 6(-1.15,-0.65)
SMC_L7.1-W6.2-LS8.1-R-RD
  rect 3.03x3.82 smd: 1(3.435,0) 2(-3.435,0)
SOT-23-3_L2.9-W1.3-P1.90-LS2.4-BR
  rect 1.25x0.7 smd: 1(1,-0.95) 2(1,0.95) 3(-1,0)
SOT-223_L6.5-W3.5-P2.30-LS7.0-BR
  rect 2.465x1.05 smd: 1(2.857,-2.3) 2(2.857,0) 3(2.857,2.3)
  rect 2.465x3.54 smd: 4(-2.857,0)

## Nets
2.048V: C6.2 C6#2.2 C6#3.2 C6#4.2 C6#5.2 C6#6.2 C6#7.2 C6#8.2 C6#9.2 C6#10.2 C6#11.2 C6#12.2 C6#13.2 C6#14.2 C6#15.2 C6#16.2 C6#17.2 C6#18.2 C6#19.2 C6#20.2 C6#21.2 C6#22.2 C6#23.2 C6#24.2 C6#25.2 C6#26.2 C6#27.2 C6#28.2 C6#29.2 C6#30.2 C6#31.2 C6#32.2 C6#33.2 C6#34.2 C6#35.2 C6#36.2 C6#37.2 C6#38.2 C6#39.2 C6#40.2 U1.2 U1#2.2 U1#3.2 U1#4.2 U1#5.2 U1#6.2 U1#7.2 U1#8.2 U1#9.2 U1#10.2 U1#11.2 U1#12.2 U1#13.2 U1#14.2 U1#15.2 U1#16.2 U1#17.2 U1#18.2 U1#19.2 U1#20.2 U1#21.2 U1#22.2 U1#23.2 U1#24.2 U1#25.2 U1#26.2 U1#27.2 U1#28.2 U1#29.2 U1#30.2 U1#31.2 U1#32.2 U1#33.2 U1#34.2 U1#35.2 U1#36.2 U1#37.2 U1#38.2 U1#39.2 U1#40.2 U2.1 U2#2.1 U2#3.1 U2#4.1 U2#5.1 U2#6.1 U2#7.1 U2#8.1 U2#9.1 U2#10.1 U2#11.1 U2#12.1 U2#13.1 U2#14.1 U2#15.1 U2#16.1 U2#17.1 U2#18.1 U2#19.1 U2#20.1 U2#21.1 U2#22.1 U2#23.1 U2#24.1 U2#25.1 U2#26.1 U2#27.1 U2#28.1 U2#29.1 U2#30.1 U2#31.1 U2#32.1 U2#33.1 U2#34.1 U2#35.1 U2#36.1 U2#37.1 U2#38.1 U2#39.1 U2#40.1 U6.13 U6#2.13 U6#3.13 U6#4.13 U6#5.13 U6#6.13 U6#7.13 U6#8.13 U6#9.13 U6#10.13 U6#11.13 U6#12.13 U6#13.13 U6#14.13 U6#15.13 U6#16.13 U6#17.13 U6#18.13 U6#19.13 U6#20.13 U6#21.13 U6#22.13 U6#23.13 U6#24.13 U6#25.13 U6#26.13 U6#27.13 U6#28.13 U6#29.13 U6#30.13 U6#31.13 U6#32.13 U6#33.13 U6#34.13 U6#35.13 U6#36.13 U6#37.13 U6#38.13 U6#39.13 U6#40.13
5V: C1.1 C1#2.1 C1#3.1 C1#4.1 C1#5.1 C1#6.1 C1#7.1 C1#8.1 C1#9.1 C1#10.1 C1#11.1 C1#12.1 C1#13.1 C1#14.1 C1#15.1 C1#16.1 C1#17.1 C1#18.1 C1#19.1 C1#20.1 C1#21.1 C1#22.1 C1#23.1 C1#24.1 C1#25.1 C1#26.1 C1#27.1 C1#28.1 C1#29.1 C1#30.1 C1#31.1 C1#32.1 C1#33.1 C1#34.1 C1#35.1 C1#36.1 C1#37.1 C1#38.1 C1#39.1 C1#40.1 C3.2 C3#2.2 C3#3.2 C3#4.2 CN1.4 CN1#2.4 CN1#3.4 CN1#4.4 CN1#5.4 CN1#6.4 CN1#7.4 CN1#8.4 CN1#9.4 CN1#10.4 CN1#11.4 CN1#12.4 CN1#13.4 CN1#14.4 CN1#15.4 CN1#16.4 CN1#17.4 CN1#18.4 CN1#19.4 CN1#20.4 CN1#21.4 CN1#22.4 CN1#23.4 CN1#24.4 CN1#25.4 CN1#26.4 CN1#27.4 CN1#28.4 CN1#29.4 CN1#30.4 CN1#31.4 CN1#32.4 CN1#33.4 CN1#34.4 CN1#35.4 CN1#36.4 CN1#37.4 CN1#38.4 CN1#39.4 CN1#40.4 CN2.1 CN2#2.1 CN2#3.1 CN2#4.1 CN2#5.1 CN2#6.1 CN2#7.1 CN2#8.1 CN2#9.1 CN2#10.1 CN2#11.1 CN2#12.1 CN2#13.1 CN2#14.1 CN2#15.1 CN2#16.1 CN2#17.1 CN2#18.1 CN2#19.1 CN2#20.1 CN2#21.1 CN2#22.1 CN2#23.1 CN2#24.1 CN2#25.1 CN2#26.1 CN2#27.1 CN2#28.1 CN2#29.1 CN2#30.1 CN2#31.1 CN2#32.1 CN2#33.1 CN2#34.1 CN2#35.1 CN2#36.1 CN2#37.1 CN2#38.1 CN2#39.1 CN2#40.1 LED1.2 LED1#2.2 LED1#3.2 LED1#4.2 LED1#5.2 LED1#6.2 LED1#7.2 LED1#8.2 LED1#9.2 LED1#10.2 LED1#11.2 LED1#12.2 LED1#13.2 LED1#14.2 LED1#15.2 LED1#16.2 LED1#17.2 LED1#18.2 LED1#19.2 LED1#20.2 LED1#21.2 LED1#22.2 LED1#23.2 LED1#24.2 LED1#25.2 LED1#26.2 LED1#27.2 LED1#28.2 LED1#29.2 LED1#30.2 LED1#31.2 LED1#32.2 LED1#33.2 LED1#34.2 LED1#35.2 LED1#36.2 LED1#37.2 LED1#38.2 LED1#39.2 LED1#40.2 LED2.2 LED2#2.2 LED2#3.2 LED2#4.2 LED2#5.2 LED2#6.2 LED2#7.2 LED2#8.2 LED2#9.2 LED2#10.2 LED2#11.2 LED2#12.2 LED2#13.2 LED2#14.2 LED2#15.2 LED2#16.2 LED2#17.2 LED2#18.2 LED2#19.2 LED2#20.2 LED2#21.2 LED2#22.2 LED2#23.2 LED2#24.2 LED2#25.2 LED2#26.2 LED2#27.2 LED2#28.2 LED2#29.2 LED2#30.2 LED2#31.2 LED2#32.2 LED2#33.2 LED2#34.2 LED2#35.2 LED2#36.2 LED2#37.2 LED2#38.2 LED2#39.2 LED2#40.2 R4.2 R4#2.2 R4#3.2 R4#4.2 R4#5.2 R4#6.2 R4#7.2 R4#8.2 R4#9.2 R4#10.2 R4#11.2 R4#12.2 R4#13.2 R4#14.2 R4#15.2 R4#16.2 R4#17.2 R4#18.2 R4#19.2 R4#20.2 R4#21.2 R4#22.2 R4#23.2 R4#24.2 R4#25.2 R4#26.2 R4#27.2 R4#28.2 R4#29.2 R4#30.2 R4#31.2 R4#32.2 R4#33.2 R4#34.2 R4#35.2 R4#36.2 R4#37.2 R4#38.2 R4#39.2 R4#40.2 R5.2 R5#2.2 R5#3.2 R5#4.2 R5#5.2 R5#6.2 R5#7.2 R5#8.2 R5#9.2 R5#10.2 R5#11.2 R5#12.2 R5#13.2 R5#14.2 R5#15.2 R5#16.2 R5#17.2 R5#18.2 R5#19.2 R5#20.2 R5#21.2 R5#22.2 R5#23.2 R5#24.2 R5#25.2 R5#26.2 R5#27.2 R5#28.2 R5#29.2 R5#30.2 R5#31.2 R5#32.2 R5#33.2 R5#34.2 R5#35.2 R5#36.2 R5#37.2 R5#38.2 R5#39.2 R5#40.2 U1.1 U1#2.1 U1#3.1 U1#4.1 U1#5.1 U1#6.1 U1#7.1 U1#8.1 U1#9.1 U1#10.1 U1#11.1 U1#12.1 U1#13.1 U1#14.1 U1#15.1 U1#16.1 U1#17.1 U1#18.1 U1#19.1 U1#20.1 U1#21.1 U1#22.1 U1#23.1 U1#24.1 U1#25.1 U1#26.1 U1#27.1 U1#28.1 U1#29.1 U1#30.1 U1#31.1 U1#32.1 U1#33.1 U1#34.1 U1#35.1 U1#36.1 U1#37.1 U1#38.1 U1#39.1 U1#40.1 U2.5 U2#2.5 U2#3.5 U2#4.5 U2#5.5 U2#6.5 U2#7.5 U2#8.5 U2#9.5 U2#10.5 U2#11.5 U2#12.5 U2#13.5 U2#14.5 U2#15.5 U2#16.5 U2#17.5 U2#18.5 U2#19.5 U2#20.5 U2#21.5 U2#22.5 U2#23.5 U2#24.5 U2#25.5 U2#26.5 U2#27.5 U2#28.5 U2#29.5 U2#30.5 U2#31.5 U2#32.5 U2#33.5 U2#34.5 U2#35.5 U2#36.5 U2#37.5 U2#38.5 U2#39.5 U2#40.5 U3.5 U3#2.5 U3#3.5 U3#4.5 U3#5.5 U3#6.5 U3#7.5 U3#8.5 U3#9.5 U3#10.5 U3#11.5 U3#12.5 U3#13.5 U3#14.5 U3#15.5 U3#16.5 U3#17.5 U3#18.5 U3#19.5 U3#20.5 U3#21.5 U3#22.5 U3#23.5 U3#24.5 U3#25.5 U3#26.5 U3#27.5 U3#28.5 U3#29.5 U3#30.5 U3#31.5 U3#32.5 U3#33.5 U3#34.5 U3#35.5 U3#36.5 U3#37.5 U3#38.5 U3#39.5 U3#40.5 U4.5 U4#2.5 U4#3.5 U4#4.5 U4#5.5 U4#6.5 U4#7.5 U4#8.5 U4#9.5 U4#10.5 U4#11.5 U4#12.5 U4#13.5 U4#14.5 U4#15.5 U4#16.5 U4#17.5 U4#18.5 U4#19.5 U4#20.5 U4#21.5 U4#22.5 U4#23.5 U4#24.5 U4#25.5 U4#26.5 U4#27.5 U4#28.5 U4#29.5 U4#30.5 U4#31.5 U4#32.5 U4#33.5 U4#34.5 U4#35.5 U4#36.5 U4#37.5 U4#38.5 U4#39.5 U4#40.5 U5.2 U5.4 U5#2.2 U5#2.4 U5#3.2 U5#3.4 U5#4.2 U5#4.4 U6.1 U6.9 U6.24 U6.48 U6#2.1 U6#2.9 U6#2.24 U6#2.48 U6#3.1 U6#3.9 U6#3.24 U6#3.48 U6#4.1 U6#4.9 U6#4.24 U6#4.48 U6#5.1 U6#5.9 U6#5.24 U6#5.48 U6#6.1 U6#6.9 U6#6.24 U6#6.48 U6#7.1 U6#7.9 U6#7.24 U6#7.48 U6#8.1 U6#8.9 U6#8.24 U6#8.48 U6#9.1 U6#9.9 U6#9.24 U6#9.48 U6#10.1 U6#10.9 U6#10.24 U6#10.48 U6#11.1 U6#11.9 U6#11.24 U6#11.48 U6#12.1 U6#12.9 U6#12.24 U6#12.48 U6#13.1 U6#13.9 U6#13.24 U6#13.48 U6#14.1 U6#14.9 U6#14.24 U6#14.48 U6#15.1 U6#15.9 U6#15.24 U6#15.48 U6#16.1 U6#16.9 U6#16.24 U6#16.48 U6#17.1 U6#17.9 U6#17.24 U6#17.48 U6#18.1 U6#18.9 U6#18.24 U6#18.48 U6#19.1 U6#19.9 U6#19.24 U6#19.48 U6#20.1 U6#20.9 U6#20.24 U6#20.48 U6#21.1 U6#21.9 U6#21.24 U6#21.48 U6#22.1 U6#22.9 U6#22.24 U6#22.48 U6#23.1 U6#23.9 U6#23.24 U6#23.48 U6#24.1 U6#24.9 U6#24.24 U6#24.48 U6#25.1 U6#25.9 U6#25.24 U6#25.48 U6#26.1 U6#26.9 U6#26.24 U6#26.48 U6#27.1 U6#27.9 U6#27.24 U6#27.48 U6#28.1 U6#28.9 U6#28.24 U6#28.48 U6#29.1 U6#29.9 U6#29.24 U6#29.48 U6#30.1 U6#30.9 U6#30.24 U6#30.48 U6#31.1 U6#31.9 U6#31.24 U6#31.48 U6#32.1 U6#32.9 U6#32.24 U6#32.48 U6#33.1 U6#33.9 U6#33.24 U6#33.48 U6#34.1 U6#34.9 U6#34.24 U6#34.48 U6#35.1 U6#35.9 U6#35.24 U6#35.48 U6#36.1 U6#36.9 U6#36.24 U6#36.48 U6#37.1 U6#37.9 U6#37.24 U6#37.48 U6#38.1 U6#38.9 U6#38.24 U6#38.48 U6#39.1 U6#39.9 U6#39.24 U6#39.48 U6#40.1 U6#40.9 U6#40.24 U6#40.48
6.5V: C2.1 C4.1 C5.2 C7.2 D1.2 R6.2 U5.3 U5#2.3 U5#3.3 U5#4.3
